# EasyEDA Pro project Archive.eprj, board GPR1.0
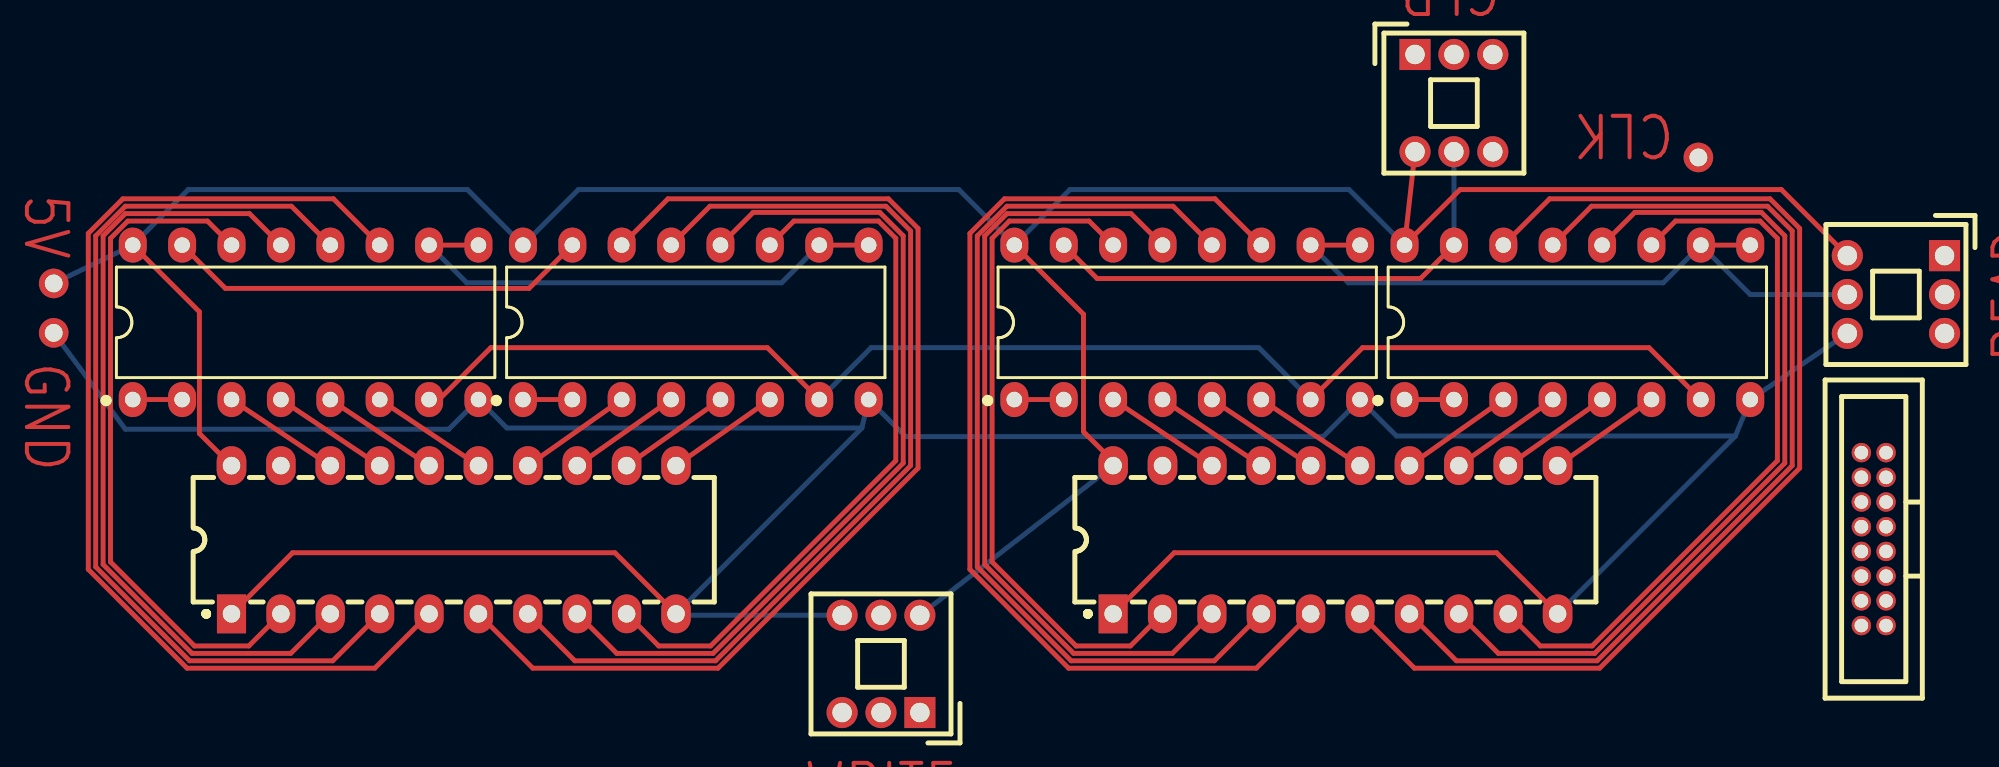
[diagram p10: board, top side]
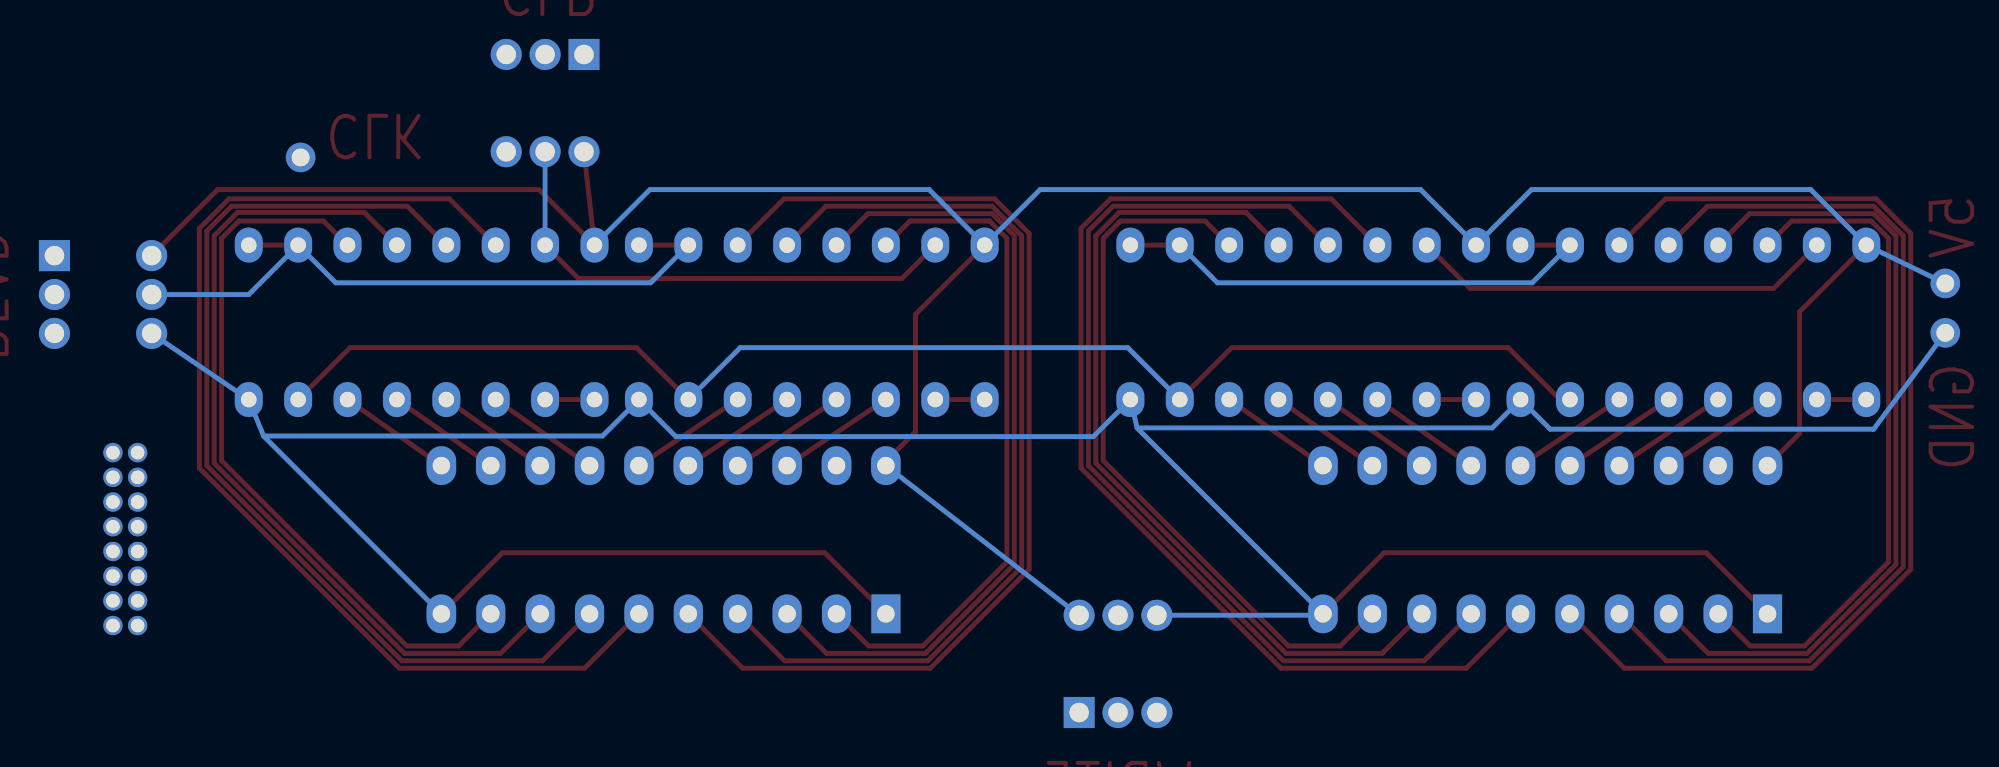
[diagram p11: board, bottom side, seen from below]

No outline. copper layers: Top Layer, Inner1, Inner2, Bottom Layer. Coordinates in mm from the lowest, leftmost part position.
Stack: Top Layer 0.035mm Outer layer thickness 1oz / Dielectric1 0.2104mm 7628 RC49% 8.6mil / Inner1 0.0152mm Inner layer thickness / Dielectric2 1.065mm 1.1mm H/HOZ Copper / Inner2 0.0152mm Inner layer thickness / Dielectric3 0.2104mm 7628 RC49% 8.6mil / Bottom Layer 0.035mm Outer layer thickness 1oz

## Design rules (mm)
template: JLCPCB Capability(Two Layers Board)
spacing copperThickness1oz (default): track to track 0.102, other pairs 0.152 to 0.3
spacing copperThickness2oz: track to track 0.203, other pairs 0.152 to 0.3
track width copperThickness1oz (default): min 0.127, default 0.254, max 2.54
track width copperThickness2oz: min 0.203, default 0.254, max 2.54
differential pair differentialPair (default): width min 0.127, default 0.254, max 2.54; gap min 0.152, default 0.152
via viaSize (default): diameter min 0.5, default 0.61, max 10; hole min 0.3, default 0.305, max 6.3

## Placement (name value [footprint] x y rotation side)
CN1  IDC16-1.27  [CONN-TH_IDC16-1.27]  93.6 6.42 90 top
NOREF  -  [Pad_e602]  84.58 26.03 0 top
NOREF#2  -  [Pad_e605]  0 19.56 180 top
NOREF#3  -  [Pad_e604]  0 17.02 180 top
SW2  -  [SW-TH_6P-L7.0-W7.0-P2.00]  94.74 18.99 0 top
SW2#2  -  [SW-TH_6P-L7.0-W7.0-P2.00]  72.01 28.83 90 top
SW2#3  -  [SW-TH_6P-L7.0-W7.0-P2.00]  42.54 0 270 top
U1  -  [PDIP-16_L19.3-W6.4-P2.54-LS7.94-BL]  12.95 17.56 0 top
U1#2  -  [PDIP-16_L19.3-W6.4-P2.54-LS7.94-BL]  58.29 17.56 0 top
U4  -  [PDIP-16_L19.3-W6.4-P2.54-LS7.94-BL]  33.02 17.56 0 top
U4#2  -  [PDIP-16_L19.3-W6.4-P2.54-LS7.94-BL]  78.36 17.56 0 top
U5  -  [DIP-20_L26.8-W6.4-P2.54-LS7.6-BL]  20.57 6.38 0 top
U5#2  -  [DIP-20_L26.8-W6.4-P2.54-LS7.6-BL]  65.91 6.38 0 top

## Footprints (pads in the part's own frame, mm; a bottom-side part is the same pattern mirrored in y, then rotated)
CONN-TH_IDC16-1.27
  round 1 hole 0.7: 1(-4.445,-0.635) 2(-4.445,0.635) 3(-3.175,-0.635) 4(-3.175,0.635) 5(-1.905,-0.635) 6(-1.905,0.635) 7(-0.635,-0.635) 8(-0.635,0.635) 9(0.635,-0.635) 10(0.635,0.635) 11(1.905,-0.635) 12(1.905,0.635) 13(3.175,-0.635) 14(3.175,0.635) 15(4.445,-0.635) 16(4.445,0.635)
DIP-20_L26.8-W6.4-P2.54-LS7.6-BL
  rect 1.5x2 hole 0.9: 1(-11.43,-3.81)
  oval 1.5x2 hole 0.9: 2(-8.89,-3.81) 3(-6.35,-3.81) 4(-3.81,-3.81) 5(-1.27,-3.81) 6(1.27,-3.81) 7(3.81,-3.81) 8(6.35,-3.81) 9(8.89,-3.81)
  oval 1.524x2 hole 0.9: 10(11.43,-3.81) 11(11.43,3.81) 12(8.89,3.81) 13(6.35,3.81) 14(3.81,3.81) 15(1.27,3.81) 16(-1.27,3.81) 17(-3.81,3.81) 18(-6.35,3.81) 19(-8.89,3.81) 20(-11.43,3.81)
Pad_e602
  round 1.524 hole 0.914: 1(0,0)
Pad_e604
  round 1.524 hole 0.914: 1(0,0)
Pad_e605
  round 1.524 hole 0.914: 2(0,0)
PDIP-16_L19.3-W6.4-P2.54-LS7.94-BL
  oval 1.44x1.8 hole 0.8: 1(-8.89,-3.97) 2(-6.35,-3.97) 3(-3.81,-3.97) 4(-1.27,-3.97) 5(1.27,-3.97) 6(3.81,-3.97) 7(6.35,-3.97) 8(8.89,-3.97) 9(8.89,3.97) 10(6.35,3.97) 11(3.81,3.97) 12(1.27,3.97) 13(-1.27,3.97) 14(-3.81,3.97) 15(-6.35,3.97) 16(-8.89,3.97)
SW-TH_6P-L7.0-W7.0-P2.00
  rect 1.6x1.6 hole 1: 1(2.499,2)
  round 1.6 hole 1: 2(2.5,0) 3(2.5,-2) 4(-2.5,2) 5(-2.5,0) 6(-2.5,-2)

## Nets

Pads without a net: CN1 1 2 3 4 5 6 7 8 9 10 11 12 13 14 15 16; NOREF 1; NOREF#2 2; NOREF#3 1; SW2 1 2 3 4 5 6; SW2#2 1 2 3 4 5 6; SW2#3 1 2 3 4 5 6; U1 1 2 3 4 5 6 7 8 9 10 11 12 13 14 15 16; U1#2 1 2 3 4 5 6 7 8 9 10 11 12 13 14 15 16; U4 1 2 3 4 5 6 7 8 9 10 11 12 13 14 15 16; U4#2 1 2 3 4 5 6 7 8 9 10 11 12 13 14 15 16; U5 1 2 3 4 5 6 7 8 9 10 11 12 13 14 15 16 17 18 19 20; U5#2 1 2 3 4 5 6 7 8 9 10 11 12 13 14 15 16 17 18 19 20

## Routing (per net, layer and track width the routed paths; a pad name or vN(x,y) marks a point on that pad's centre or on a via; arc(x,y) is an arc through that point)
(no net): length 2374.7
  Top Layer w0.254: U4#2.5 U5#2.12 ; U4.15 24.44,19.3 8.83,19.3 U1.15 ; U4#2.4 U5#2.13 ; U1#2.13 55.41,23.15 49.02,23.15 47.88,22 47.88,5.11 52.45,0.54 57.53,0.54 U5#2.3 ; U1#2.3 U5#2.18 ; U1.6 U5.15 ; U4.3 U5.14 ; U5.5 16.51,-0.22 6.86,-0.22 1.78,4.86 1.78,22.13 3.56,23.91 14.38,23.91 U1.11 ; U5#2.7 72.14,0.16 79.38,0.16 89.41,10.19 89.41,22.26 88.14,23.53 79.09,23.53 U4#2.13 ; U5.7 26.8,0.16 34.04,0.16 44.07,10.19 44.07,22.26 42.8,23.53 33.75,23.53 U4.13 ; U1#2.11 59.72,23.91 48.89,23.91 47.12,22.13 47.12,4.86 52.2,-0.22 61.85,-0.22 U5#2.5 ; U4.14 31.59,23.91 42.93,23.91 44.45,22.39 44.45,10.07 34.16,-0.22 24.64,-0.22 U5.6 ; U5#2.20 54.48,10.41 52.96,11.94 52.96,17.97 U1#2.16 ; U1.7 19.81,13.59 22.48,16.26 36.7,16.26 U4.7 ; U5#2.10 74.2,5.72 57.62,5.72 U5#2.1 ; U4#2.14 76.93,23.91 88.26,23.91 89.79,22.39 89.79,10.07 79.5,-0.22 69.98,-0.22 U5#2.6 ; U4.1 U4.2 ; U1#2.4 U5#2.17 ; U1.5 U5.16 ; U1#2.10 U1#2.9 ; U4#2.11 83.41,22.77 87.76,22.77 88.65,21.88 88.65,10.45 79.12,0.92 76.45,0.92 U5#2.9 ; U4.5 U5.12 ; U1#2.2 U1#2.1 ; U4.4 U5.13 ; U4#2.1 72.01,13.59 ; SW2#2.4 U4#2.16 72.32,24.38 88.85,24.38 SW2.4 ; U1.3 U5.18 ; U1#2.14 53.25,22.77 49.15,22.77 48.26,21.88 48.26,5.24 52.58,0.92 55.37,0.92 U5#2.2 ; U1.12 12.22,23.53 3.68,23.53 2.16,22 2.16,4.99 6.98,0.16 14.35,0.16 U5.4 ; U5.1 12.29,5.72 28.86,5.72 U5.10 ; U1.2 U1.1 ; U5#2.4 59.69,0.16 52.32,0.16 47.5,4.99 47.5,22 49.02,23.53 57.56,23.53 U1#2.12 ; U1#2.15 53.66,19.81 70.29,19.81 72.01,21.53 ; U1#2.7 67.31,16.26 82.04,16.26 U4#2.7 ; U4#2.12 81.31,23.21 87.82,23.21 89.03,22 89.03,10.32 79.25,0.54 74.3,0.54 U5#2.8 ; U5.3 12.19,0.54 7.11,0.54 2.54,5.11 2.54,22 3.68,23.15 10.07,23.15 U1.13 ; U1.10 U1.9 ; U5.20 7.49,11.84 7.49,18.1 U1.16 ; U5.8 28.96,0.54 33.91,0.54 43.69,10.32 43.69,22 42.48,23.21 35.97,23.21 U4.12 ; U4.10 U4.9 ; U1.4 U5.17 ; U1#2.5 U5#2.16 ; U5.9 31.12,0.92 33.78,0.92 43.31,10.45 43.31,21.88 42.42,22.77 38.07,22.77 U4.11 ; U4#2.10 U4#2.9 ; U4#2.3 U5#2.14 ; U4.6 U5.11 ; U1#2.6 U5#2.15 ; U1.14 7.91,22.77 3.81,22.77 2.92,21.88 2.92,5.24 7.24,0.92 10.03,0.92 U5.2 ; U4#2.6 U5#2.11
  Inner1 w0.254: U1#2.15 49.72,19.3 28.89,19.3 U4.15 ; U4#2.7 85.85,14.73 85.85,22.22 84.58,23.5 NOREF.1 ; U1#2.8 73.28,19.69 73.28,22.73 SW2#2.6 ; U5.19 13.11,8.76 42.54,8.76 ; U5#2.19 55.59,8.76 42.54,8.76 ; 42.54,8.76 SW2#3.5
  Inner2 w0.254: U5#2.2 61.25,6.8 88.9,6.8 CN1.16 ; CN1.13 97.15,6.67 97.15,-0.7 96.01,-1.84 18.64,-1.84 U5.3 ; U5#2.5 67.72,5.65 91.57,5.65 CN1.10 ; U5.7 27.27,-0.31 94.11,-0.31 95.5,1.08 95.5,3.11 94.23,4.38 CN1.5 ; CN1.14 89.79,6.42 63.41,6.42 U5#2.3 ; CN1.12 90.68,6.03 65.56,6.03 U5#2.4 ; CN1.7 96.01,4 96.01,0.45 94.87,-0.7 25.11,-0.7 U5.6 ; U5.9 31.59,0.45 92.84,0.45 94.23,1.84 CN1.1 ; U5#2.9 76.36,4.13 90.81,4.13 CN1.2 ; CN1.6 92.58,4.89 72.04,4.89 U5#2.7 ; CN1.11 96.77,5.78 96.77,-0.19 95.5,-1.46 20.79,-1.46 U5.4 ; CN1.9 96.39,4.89 96.39,0.19 95.12,-1.08 22.95,-1.08 U5.5 ; CN1.4 91.69,4.51 74.2,4.51 U5#2.8 ; CN1.8 92.46,5.78 91.95,5.27 69.88,5.27 U5#2.6 ; CN1.15 97.54,7.56 97.54,-0.82 96.14,-2.22 16.48,-2.22 U5.2 ; U5.8 29.43,0.07 93.47,0.07 95,1.59 95,2.48 CN1.3
  Bottom Layer w0.254: U1#2.7 61.98,16.26 42.04,16.26 U4.7 ; 41.56,12.13 23.3,12.13 U1.8 20.32,12.06 3.68,12.06 NOREF#3.1 ; 41.56,12.13 U4.8 43.81,11.68 65.28,11.68 U1#2.8 69.06,11.72 86.49,11.72 ; 41.56,12.13 U5.10 32.08,2.5 SW2#3.6 ; 86.49,11.72 U4#2.8 SW2.6 ; 86.49,11.72 U5#2.10 ; U4.10 37.43,19.59 21.24,19.59 U1.10 ; U1#2.10 66.58,19.59 82.77,19.59 U4#2.10 87.25,18.99 SW2.5 ; NOREF#2.2 U1.16 6.92,24.38 21.28,24.38 U4.16 26.98,24.38 46.55,24.38 U1#2.16 52.26,24.38 66.61,24.38 U4#2.16 ; U5#2.20 SW2#3.4 ; SW2#2.5 72.01,21.53

## Text on the board
Top Layer: WRITE | CLR | CLK | 5V | GND | READ
